# EasyEDA Pro project Q's HelloWorld KeyBoard.eprj, schematic SCH数字键盘主控板
Create Date: 2022-10-16; Page Name: P1; Project Name: Q's HelloWorld KeyBoard; Schematic Name: SCH数字键盘主控板; Update Date: 2022-10-17; Company: 嘉立创EDA; Page Size: A3; Version: V1.0
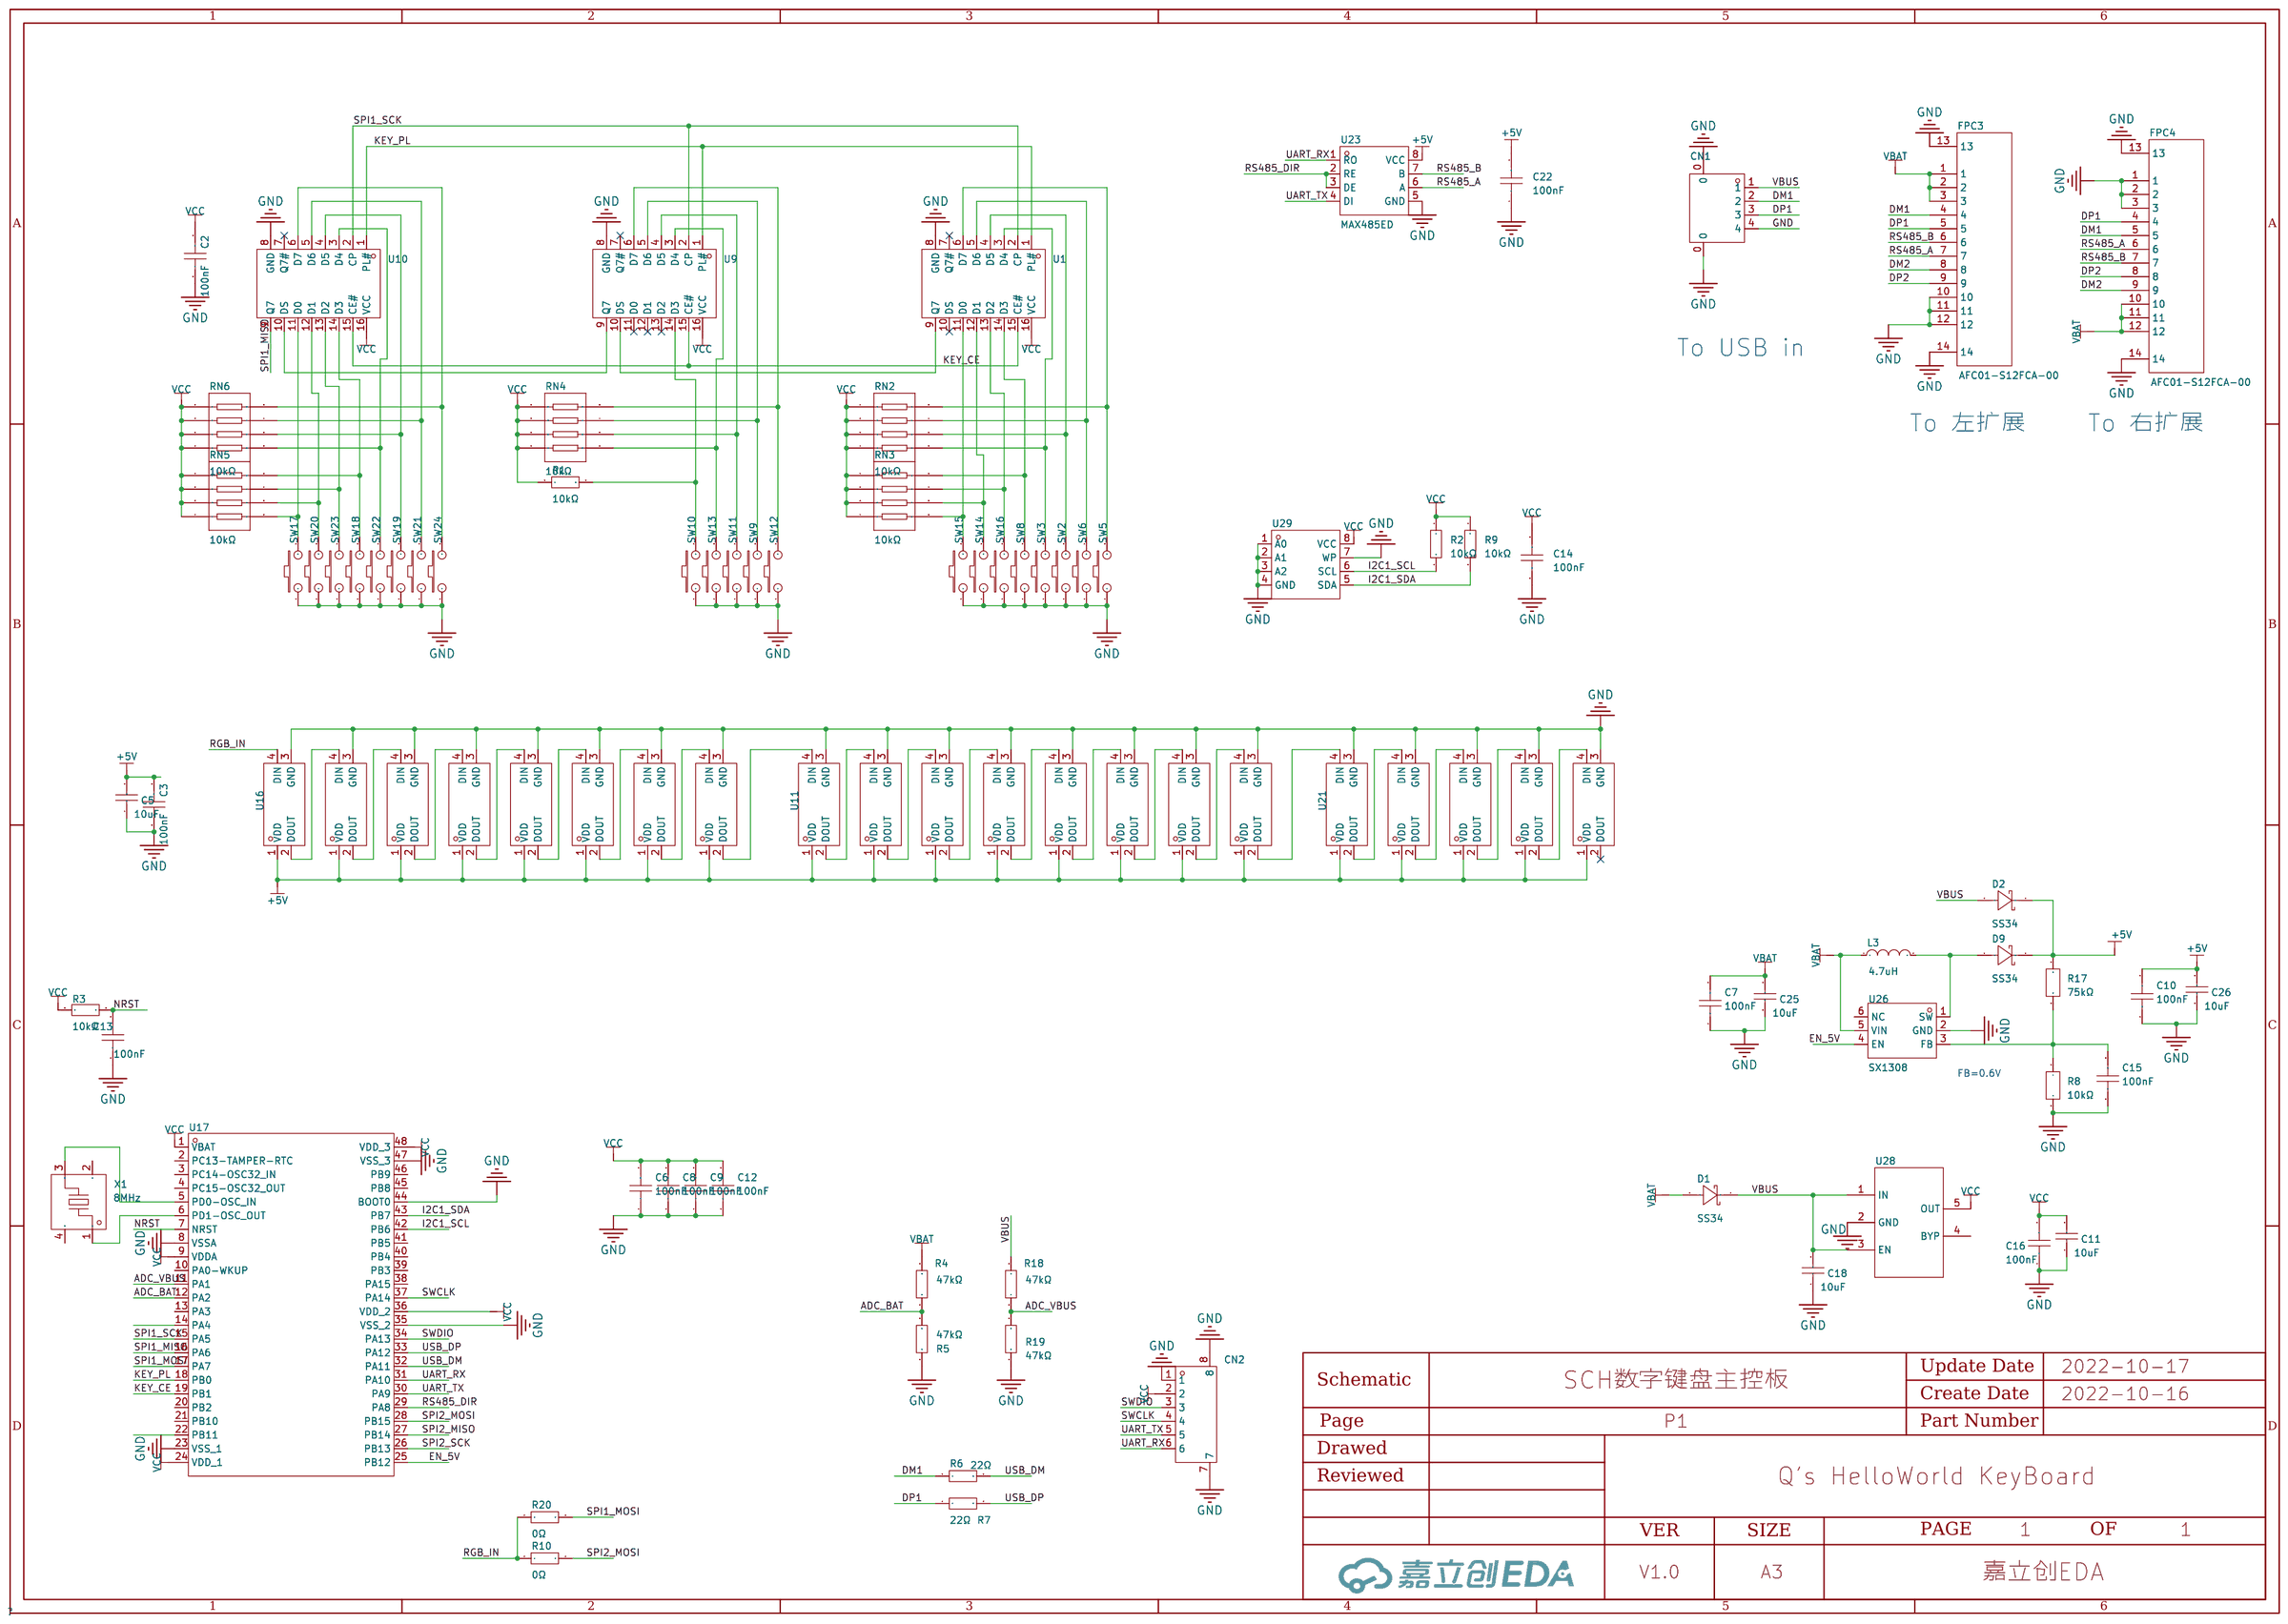
[diagram p9: schematic sheet]

## Parts
C2  100nF  [C0402]
C3  100nF  [C0402]
C5  10uF  [C0402]
C6  100nF  [C0402]
C7  100nF  [C0402]
C8  100nF  [C0402]
C9  100nF  [C0402]
C10  100nF  [C0402]
C11  10uF  [C0402]
C12  100nF  [C0402]
C13  100nF  [C0402]
C14  100nF  [C0402]
C15  100nF  [C0402]
C16  100nF  [C0402]
C18  10uF  [C0402]
C22  100nF  [C0402]
C25  10uF  [C0402]
C26  10uF  [C0402]
CN1  1.0T-4P卧贴  [CONN-SMD_1.0T-4P]
CN2  1.0K-BH-6PWB  [CONN-SMD_6P-P1.00_HDGC_1.0K-BH-6PWB]
D1  SS34  [SMA_L4.3-W2.6-LS5.2-RD]
D2  SS34  [SMA_L4.3-W2.6-LS5.2-RD]
D9  SS34  [SMA_L4.3-W2.6-LS5.2-RD]
FPC3  AFC01-S12FCA-00  [FPC-SMD_AFC01-S12FCA-00]
FPC4  AFC01-S12FCA-00  [FPC-SMD_AFC01-S12FCA-00]
L3  4.7uH  [IND-SMD_L5.8-W5.2]
R1  10kΩ  [R0402]
R2  10kΩ  [R0402]
R3  10kΩ  [R0402]
R4  47kΩ  [R0402]
R5  47kΩ  [R0402]
R6  22Ω  [R0402]
R7  22Ω  [R0402]
R8  10kΩ  [R0402]
R9  10kΩ  [R0402]
R10  0Ω  [R0402]
R17  75kΩ  [R0402]
R18  47kΩ  [R0402]
R19  47kΩ  [R0402]
R20  0Ω  [R0402]
RN2  10kΩ  [RES-ARRAY-SMD_0402-8P-L2.0-W1.0-BL]
RN3  10kΩ  [RES-ARRAY-SMD_0402-8P-L2.0-W1.0-BL]
RN4  10kΩ  [RES-ARRAY-SMD_0402-8P-L2.0-W1.0-BL]
RN5  10kΩ  [RES-ARRAY-SMD_0402-8P-L2.0-W1.0-BL]
RN6  10kΩ  [RES-ARRAY-SMD_0402-8P-L2.0-W1.0-BL]
SW2  -  [轴座_焊接热插拔_不带灯]
SW3  -  [轴座_焊接热插拔_不带灯]
SW5  -  [轴座_焊接热插拔_不带灯]
SW6  -  [轴座_焊接热插拔_不带灯]
SW8  -  [轴座_焊接热插拔_不带灯]
SW9  -  [轴座_焊接热插拔_不带灯]
SW10  -  [轴座_焊接热插拔_不带灯]
SW11  -  [轴座_焊接热插拔_不带灯]
SW12  -  [轴座_焊接热插拔_不带灯]
SW13  -  [轴座_焊接热插拔_不带灯]
SW14  -  [轴座_焊接热插拔_不带灯]
SW15  -  [轴座_焊接热插拔_不带灯]
SW16  -  [轴座_焊接热插拔_不带灯]
SW17  -  [轴座_焊接热插拔_不带灯]
SW18  -  [轴座_焊接热插拔_不带灯]
SW19  -  [轴座_焊接热插拔_不带灯]
SW20  -  [轴座_焊接热插拔_不带灯]
SW21  -  [轴座_焊接热插拔_不带灯]
SW22  -  [轴座_焊接热插拔_不带灯]
SW23  -  [轴座_焊接热插拔_不带灯]
SW24  -  [轴座_焊接热插拔_不带灯]
U1  74HC165D,653  [SOIC-16_L9.9-W3.9-P1.27-LS6.0-BL]
U2  Yo-WS2812B-3528反贴雾状  [LED-SMD_L3.2-W2.8-BR_DY-S352818]
U3  Yo-WS2812B-3528反贴雾状  [LED-SMD_L3.2-W2.8-BR_DY-S352818]
U4  Yo-WS2812B-3528反贴雾状  [LED-SMD_L3.2-W2.8-BR_DY-S352818]
U5  Yo-WS2812B-3528反贴雾状  [LED-SMD_L3.2-W2.8-BR_DY-S352818]
U6  Yo-WS2812B-3528反贴雾状  [LED-SMD_L3.2-W2.8-BR_DY-S352818]
U7  Yo-WS2812B-3528反贴雾状  [LED-SMD_L3.2-W2.8-BR_DY-S352818]
U8  Yo-WS2812B-3528反贴雾状  [LED-SMD_L3.2-W2.8-BR_DY-S352818]
U9  74HC165D,653  [SOIC-16_L9.9-W3.9-P1.27-LS6.0-BL]
U10  74HC165D,653  [SOIC-16_L9.9-W3.9-P1.27-LS6.0-BL]
U11  Yo-WS2812B-3528反贴雾状  [LED-SMD_L3.2-W2.8-BR_DY-S352818]
U12  Yo-WS2812B-3528反贴雾状  [LED-SMD_L3.2-W2.8-BR_DY-S352818]
U13  Yo-WS2812B-3528反贴雾状  [LED-SMD_L3.2-W2.8-BR_DY-S352818]
U14  Yo-WS2812B-3528反贴雾状  [LED-SMD_L3.2-W2.8-BR_DY-S352818]
U15  Yo-WS2812B-3528反贴雾状  [LED-SMD_L3.2-W2.8-BR_DY-S352818]
U16  Yo-WS2812B-3528反贴雾状  [LED-SMD_L3.2-W2.8-BR_DY-S352818]
U17  STM32F103C8T6  [LQFP-48_L7.0-W7.0-P0.50-LS9.0-BL]
U18  Yo-WS2812B-3528反贴雾状  [LED-SMD_L3.2-W2.8-BR_DY-S352818]
U19  Yo-WS2812B-3528反贴雾状  [LED-SMD_L3.2-W2.8-BR_DY-S352818]
U20  Yo-WS2812B-3528反贴雾状  [LED-SMD_L3.2-W2.8-BR_DY-S352818]
U21  Yo-WS2812B-3528反贴雾状  [LED-SMD_L3.2-W2.8-BR_DY-S352818]
U22  Yo-WS2812B-3528反贴雾状  [LED-SMD_L3.2-W2.8-BR_DY-S352818]
U23  MAX485ED  [SOP-8_L4.9-W3.9-P1.27-LS6.0-BL]
U24  Yo-WS2812B-3528反贴雾状  [LED-SMD_L3.2-W2.8-BR_DY-S352818]
U25  Yo-WS2812B-3528反贴雾状  [LED-SMD_L3.2-W2.8-BR_DY-S352818]
U26  SX1308  [SOT-23-6_L2.9-W1.6-P0.95-LS2.8-BR]
U27  Yo-WS2812B-3528反贴雾状  [LED-SMD_L3.2-W2.8-BR_DY-S352818]
U28  -  [SOT-23-5_L3.0-W1.7-P0.95-LS2.8-BR]
U29  AT24C02  [SOP-8_L5.0-W4.0-P1.27-LS6.0-BL]
X1  8MHz  [OSC-SMD_4P-L3.2-W2.5-BL]

## Library data of the parts
C2 C3 C6-C10 C12-C16 C22 = GCM155R71C104KA55J: 容值:100nF;精度:±10%;额定电压:-;材质(温度系数):-;; LCSC Part Name: 100nF ±10%; Supplier Part: C2655418; Manufacturer: muRata(村田); Supplier Footprint: 0402; JLCPCB Part Class: Extended Part; Datasheet: https://atta.szlcsc.com/upload/public/pdf/source/20210701/42090801FDE37D0E45AFF657247F4A08.pdf; Supplier: LCSC; Tolerance: ±10%
C5 C11 C18 C25 C26 = CL05A106MQ5NUNC: 容值:10uF;精度:±20%;额定电压:6.3V;材质(温度系数):X5R;; LCSC Part Name: 10uF ±20% 6.3V; Supplier Part: C15525; Manufacturer: SAMSUNG(三星); Supplier Footprint: 0402; JLCPCB Part Class: Basic Part; Datasheet: https://atta.szlcsc.com/upload/public/pdf/source/20220823/2B02EE04F8F211D38A52DCB16EB6BEBA.pdf; Supplier: LCSC; Tolerance: ±20%; Voltage Rated: 6.3V; Temperature Coefficient: X5R
CN1 = 1.0T-4P卧贴: 参考系列:SH;间距:1mm;插针结构:1x4P;排数:1;每排PIN数:4;行距:-;安装方式:-;触头材质:磷铜;; LCSC Part Name: 插座 1*4P 卧贴 卧贴; Supplier Part: C145956; Manufacturer: BOOMELE(博穆精密); Supplier Footprint: SMD,P=1mm; JLCPCB Part Class: Extended Part; Datasheet: https://atta.szlcsc.com/upload/public/pdf/source/20171115/C145956_15107293415261120441.pdf; Supplier: LCSC; Reference Series: SH; Pitch: 1mm; Pins Structure: 1x4P; Number of Rows: 1; Number of PINs Per Row: 4; Contact Material: 磷铜
CN2 = 1.0K-BH-6PWB: 参考系列:-;间距:1mm;插针结构:1x6P;排数:1;每排PIN数:6;行距:-;公母:公型插针;安装方式:卧贴;额定电流:-;工作温度范围:-25~+85;; LCSC Part Name: 1x6P 间距P=1.0mm 卧贴 SMT; Supplier Part: C2919607; Manufacturer: HDGC(华德共创); Supplier Footprint: SMD,P=1mm; JLCPCB Part Class: Extended Part; Datasheet: https://atta.szlcsc.com/upload/public/pdf/source/20211115/0C4A9B301513FDEAA34F959002791CED.pdf; Supplier: LCSC; Pitch: 1mm; Pins Structure: 1x6P; Number of Rows: 1; Number of PINs Per Row: 6; Gender: 公型插针; Mounting Style: 卧贴; Operating Temperature Range: -25~+85
D1 D2 D9 = SS34_C3032484: Supplier Part: C3032484; Manufacturer: TDD(台冠电子); Supplier Footprint: SMA; JLCPCB Part Class: Extended Part; Datasheet: https://atta.szlcsc.com/upload/public/pdf/source/20220622/9D70D0693761B542BF6F533590093AA5.pdf; Supplier: LCSC
FPC3 FPC4 = AFC01-S12FCA-00: 间距:0.5mm;触点数量:12;锁定特性:翻盖式;安装类型:卧贴;触点类型:下接;; LCSC Part Name: 0.5mm P数:12 翻盖式 下接; Supplier Part: C262661; Manufacturer: JS(钜硕电子); Supplier Footprint: SMD,P=0.5mm; JLCPCB Part Class: Extended Part; Datasheet: https://atta.szlcsc.com/upload/public/pdf/source/20180810/C262661_216573474FA4FCB7E7D6D6C5859A7896.pdf; Supplier: LCSC; Pitch: 0.5mm; Number of Contacts: 12; Locking Feature: 翻盖式; Mounting Type: 卧贴; Contact Type: 下接; Height Above Board: 2mm; FFC, FCB Thickness: 0.3mm
L3 = CD54-4R7M-T-Z: 电感值:4.7uH;精度:±20%;额定电流:-;直流电阻(DCR):-;; LCSC Part Name: 4.7uH ±20%; Supplier Part: C501775; Manufacturer: Me-TECH(美台高科); Supplier Footprint: SMD; JLCPCB Part Class: Extended Part; Datasheet: https://atta.szlcsc.com/upload/public/pdf/source/20200324/C501728_0ED92A661C9AA91DB0CB8AF3A2A8117A.pdf; Supplier: LCSC; Tolerance: ±20%
R1 = RC0402FR-0710KL: 最大工作电压:50V;阻值:10kΩ;工作温度范围:-55~+155;电阻长:-;精度:±1%;电阻直径:-;电阻高:-;电阻宽:-;电阻类型:厚膜电阻;功率:62.5mW;温度系数:±100ppm/;; LCSC Part Name: 10kΩ ±1%; Supplier Part: C60490; Manufacturer: YAGEO(国巨); Supplier Footprint: 0402; JLCPCB Part Class: Extended Part; Datasheet: https://atta.szlcsc.com/upload/public/pdf/source/20170606/1496716515432.pdf; Supplier: LCSC; Overload Voltage (Max): 50V; Operating Temperature Range: -55~+155; Tolerance: ±1%; Type: 厚膜电阻; Power(Watts): 62.5mW; Temperature Coefficient: ±100ppm/
R2 R3 R9 = AECR0402F10K0K9: 功率:0.063W;阻值:10kΩ;精度:±1%;; LCSC Part Name: 10KΩ(1002) ±1%; Supplier Part: C328298; Manufacturer: RESI(开步睿思）; Supplier Footprint: 0402; JLCPCB Part Class: Extended Part; Datasheet: https://atta.szlcsc.com/upload/public/pdf/source/20181108/C328298_2E8721712DFDC25EDA989FDD55A2877F.pdf; Supplier: LCSC; Power(Watts): 0.063W; Tolerance: ±1%
R4 R5 R18 R19 = RC-02W4702FT: 阻值:47kΩ;精度:±1%;功率:62.5mW;温度系数:±200ppm/;最大工作电压:50V;工作温度范围:-55~+155;; LCSC Part Name: 47kΩ ±1% 62.5mW; Supplier Part: C286560; Manufacturer: FH(风华); Supplier Footprint: 0402; JLCPCB Part Class: Extended Part; Datasheet: https://atta.szlcsc.com/upload/public/pdf/source/20180928/C286560_BD6B595325C950E64D46B3EA58FB4E6A.pdf; Supplier: LCSC; Tolerance: ±1%; Power(Watts): 62.5mW; Temperature Coefficient: ±200ppm/; Overload Voltage (Max): 50V; Operating Temperature Range: -55~+155
R6 R7 = RC0402FR-0722RL: 最大工作电压:50V;工作温度范围:-55~+155;电阻长:-;精度:±1%;电阻直径:-;电阻高:-;电阻宽:-;电阻类型:厚膜电阻;功率:62.5mW;温度系数:±100ppm/;阻值:22Ω;; LCSC Part Name: 22Ω ±1%; Supplier Part: C114765; Manufacturer: YAGEO(国巨); Supplier Footprint: 0402; JLCPCB Part Class: Extended Part; Datasheet: https://atta.szlcsc.com/upload/public/pdf/source/20170912/C114765_1505207820880963483.pdf; Supplier: LCSC; Overload Voltage (Max): 50V; Operating Temperature Range: -55~+155; Tolerance: ±1%; Type: 厚膜电阻; Power(Watts): 62.5mW; Temperature Coefficient: ±100ppm/
R8 R17 = CRCW0402100KJNED: 电阻类型:-;阻值:100kΩ;精度:±5%;功率:63mW;温度系数:±200ppm/K;最大工作电压:75V;工作温度范围:-55~+155;; LCSC Part Name: 100kΩ ±5%; Supplier Part: C482245; Manufacturer: VISHAY(威世); Supplier Footprint: 0402; JLCPCB Part Class: Extended Part; Datasheet: https://atta.szlcsc.com/upload/public/pdf/source/20200618/C481956_E25174B008CE8C884BEDD7D4D15E674F.pdf; Supplier: LCSC; Tolerance: ±5%; Power(Watts): 63mW; Temperature Coefficient: ±200ppm/K; Overload Voltage (Max): 75V; Operating Temperature Range: -55~+155
R10 R20 = 0402WGJ0000TCE: 温度系数:-;精度:±5%;功率:1/16W;阻值:0Ω;最大工作电压:50V;工作温度范围:-55~+155;; LCSC Part Name: 0Ω ±5%; Supplier Part: C21376; Manufacturer: UNI-ROYAL(厚声); Supplier Footprint: 0402; JLCPCB Part Class: Extended Part; Datasheet: https://atta.szlcsc.com/upload/public/pdf/source/20170920/C21376_1505887444166980543.pdf; Supplier: LCSC; Tolerance: ±5%; Power(Watts): 1/16W; Overload Voltage (Max): 50V; Operating Temperature Range: -55~+155
RN2-RN6 = 4D02WGJ0103TCE: 阻值:10kΩ;精度:±5%;单个元件功率:62.5mW;温度系数:±200ppm/;电阻器数:4;引脚数:8;; LCSC Part Name: 10kΩ ±5%; Supplier Part: C25725; Manufacturer: UNI-ROYAL(厚声); Supplier Footprint: 0402x4; JLCPCB Part Class: Basic Part; Datasheet: https://atta.szlcsc.com/upload/public/pdf/source/20170615/1497510998113.pdf; Supplier: LCSC; Tolerance: ±5%; Power(Watts): 62.5mW; Temperature Coefficient: ±200ppm/; Number of Resistors: 4; Number of Pins: 8
SW2 SW3 SW5 SW6 SW8-SW24 = KEYBOARD-SW: Origin Footprint 2: MX-KEY
U1 U9 U10 = 74HC165D,653: Supplier Part: C5613; Manufacturer: Nexperia(安世); Supplier Footprint: SOIC-16_150mil; JLCPCB Part Class: Basic Part; Datasheet: https://atta.szlcsc.com/upload/public/pdf/source/20160218/1457707760975.pdf; Supplier: LCSC
U2-U8 U11-U16 U18-U22 U24 U25 U27 = YO-WS2812B-3528反贴: Supplier: LCSC; Supplier Part: C9900003682; Manufacturer: null
U17 = STM32F103C8T6: CPU内核:ARM Cortex-M3;CPU最大主频:72MHz;工作电压范围:2V~3.6V;内部振荡器:有;程序 FLASH容量:64K@x8bit;RAM总容量:20KB;EEPROM/数据 FLASH容量:-;GPIO端口数量:37;ADC(单元数/通道数/位数):1@x10ch/12bit;外设/功能/协议栈:温度传感器；DMA；看门狗；POR；PWM;工作温度范围:-40~+85;; LCSC Part Name: ARM Cortex-M3 72MHz 64K@x8bit 20KB MSL=3; Supplier Part: C8734; Manufacturer: ST(意法半导体); Supplier Footprint: LQFP-48_7x7x05P; JLCPCB Part Class: Basic Part; Datasheet: https://atta.szlcsc.com/upload/public/pdf/source/20140724/1457707174202.pdf; Supplier: LCSC; CPU Core: ARM Cortex-M3; Maximum Frequency: 72MHz; Supply Voltage Range: 2V~3.6V; Internal Oscillator: 有; Program FLASH Size: 64K@x8bit; RAM Size: 20KB; GPIO Ports Number: 37; ADC (Units/Channels/bits): 1@x10ch/12bit; Peripherals / Functions / Protocol Stacks: 温度传感器；DMA；看门狗；POR；PWM; Operating Temperature Range: -40~+85
U23 = MAX485ED: 类型:-;协议类别:-;驱动器/接收器数:-;数据速率:-;; Supplier Part: C481667; Manufacturer: HTC; Supplier Footprint: SOP-8; JLCPCB Part Class: Extended Part; Datasheet: https://atta.szlcsc.com/upload/public/pdf/source/20200113/C481667_86CA12344B2034BBC3F3085D860BEB7C.pdf; Supplier: LCSC
U26 = SX1308: 功能类型:升压型;同步整流:否;输出通道数:1;拓扑结构:升压式;输入电压:2V~24V;输出电压:28V;输出电流(最大值):-;开关频率:1.2MHz;; LCSC Part Name: 升压型 2V~24V 1.2MHz; Supplier Part: C78162; Manufacturer: SX(硕芯科技); Supplier Footprint: SOT-23-6; JLCPCB Part Class: Extended Part; Datasheet: https://atta.szlcsc.com/upload/public/pdf/source/20160920/1474356679185.pdf; Supplier: LCSC; Function: 升压型; Synchronous Rectification: 否; Number of Outputs: 1; Topology: 升压式; Input Voltage: 2V~24V; Output Voltage: 28V; Switching Frequency: 1.2MHz
U28 = SPX3819M5-L-3-3/TR: 输出类型:固定;输出极性:正;输出通道数:1;最大输入电压:16V;输出电压:3.3V;压差:700mV@(500mA);输出电流:500mA;电源纹波抑制比(PRSS):70dB;; LCSC Part Name: Vin=16V Vout=3.3V 500mA 70dB; Supplier Part: C9055; Manufacturer: MaxLinear; Supplier Footprint: SOT-23-5; JLCPCB Part Class: 扩展库; Datasheet: https://atta.szlcsc.com/upload/public/pdf/source/20160421/1461205045150.pdf; Supplier: LCSC; Output Type: 固定; Output Polarity: 正; Number of Outputs: 1; Maximum Input Voltage: 16V; Output Voltage: 3.3V; Dropout Voltage: 700mV@(500mA); Output Current: 500mA; Power Supply Rejection Ratio (PRSS): 70dB
U29 = AT24C02_C688857: Supplier Part: C688857; Manufacturer: IDCHIP(英锐芯); Supplier Footprint: SOP-8; JLCPCB Part Class: Extended Part; Datasheet: https://atta.szlcsc.com/upload/public/pdf/source/20200619/C688857_168265888F77B455D6D4136881F4BB15.pdf; Supplier: LCSC
X1 = 3225-8.00-10-10-10/A: 晶振类型:贴片无源晶振;频率:8MHz;频率公差:±10ppm;频率稳定度:-;负载电容:10pF;工作温度:-;; LCSC Part Name: 8MHz ±10ppm 10pF; Supplier Part: C518154; Manufacturer: LIMING(利明); Supplier Footprint: SMD3225-4P; JLCPCB Part Class: Extended Part; Datasheet: https://atta.szlcsc.com/upload/public/pdf/source/20200603/C518143_C28693AFC6B5677A46756E3C75F63174.pdf; Supplier: LCSC; Crystal Type: 贴片无源晶振; Frequency Tolerance: ±10ppm; Load Capacitance: 10pF

## Nets
+5V: C3.1 C5.2 C10.2 C22.2 C26.2 D2.1(K) D9.1(K) R17.1 U2.1(VDD) U3.1(VDD) U4.1(VDD) U5.1(VDD) U6.1(VDD) U7.1(VDD) U8.1(VDD) U11.1(VDD) U12.1(VDD) U13.1(VDD) U14.1(VDD) U15.1(VDD) U16.1(VDD) U18.1(VDD) U19.1(VDD) U20.1(VDD) U21.1(VDD) U22.1(VDD) U23.8(VCC) U24.1(VDD) U25.1(VDD) U27.1(VDD)
GND: C2.2 C3.2 C5.1 C6.1 C7.1 C8.1 C9.1 C10.1 C11.1 C12.1 C13.1 C14.1 C15.1 C16.1 C18.1 C22.1 C25.1 C26.1 CN1.0 CN1.4 CN2.1 CN2.7 CN2.8 FPC3.10 FPC3.11 FPC3.12 FPC3.13 FPC3.14 FPC4.1 FPC4.2 FPC4.3 FPC4.13 FPC4.14 R5.1 R8.2 R19.1 SW2.1 SW3.1 SW5.1 SW6.1 SW8.1 SW9.1 SW10.1 SW11.1 SW12.1 SW13.1 SW14.1 SW15.1 SW16.1 SW17.1 SW18.1 SW19.1 SW20.1 SW21.1 SW22.1 SW23.1 SW24.1 U1.8(GND) U2.3(GND) U3.3(GND) U4.3(GND) U5.3(GND) U6.3(GND) U7.3(GND) U8.3(GND) U9.8(GND) U10.8(GND) U11.3(GND) U12.3(GND) U13.3(GND) U14.3(GND) U15.3(GND) U16.3(GND) U17.8(VSSA) U17.23(VSS_1) U17.35(VSS_2) U17.44(BOOT0) U17.47(VSS_3) U18.3(GND) U19.3(GND) U20.3(GND) U21.3(GND) U22.3(GND) U23.5(GND) U24.3(GND) U25.3(GND) U26.2(GND) U27.3(GND) U28.2(GND) U29.1(A0) U29.2(A1) U29.3(A2) U29.4(GND) U29.7(WP)
VBAT: C7.2 C25.2 D1.2(A) FPC3.1 FPC3.2 FPC3.3 FPC4.10 FPC4.11 FPC4.12 L3.1 R4.2 U26.5(VIN)
VBUS: C18.2 CN1.1 D1.1(K) D2.2(A) R18.2 U28.1(IN) U28.3(EN)
VCC: C2.1 C6.2 C8.2 C9.2 C11.2 C12.2 C14.2 C16.2 CN2.2 R1.1 R2.1 R3.2 R9.1 RN2.1 RN2.2 RN2.3 RN2.4 RN3.1 RN3.2 RN3.3 RN3.4 RN4.1 RN4.2 RN4.3 RN4.4 RN5.1 RN5.2 RN5.3 RN5.4 RN6.1 RN6.2 RN6.3 RN6.4 U1.16(VCC) U9.16(VCC) U10.16(VCC) U17.1(VBAT) U17.9(VDDA) U17.24(VDD_1) U17.36(VDD_2) U17.48(VDD_3) U28.5(OUT) U29.8(VCC)
ADC_BAT: R4.1 R5.2 U17.12(PA2)
ADC_VBUS: R18.1 R19.2 U17.11(PA1)
DM1: CN1.2 FPC3.4 FPC4.5 R6.1
DM2: FPC3.8 FPC4.9
DP1: CN1.3 FPC3.5 FPC4.4 R7.1
DP2: FPC3.9 FPC4.8
EN_5V: U17.25(PB12) U26.4(EN)
I2C1_SCL: R2.2 U17.42(PB6) U29.6(SCL)
I2C1_SDA: R9.2 U17.43(PB7) U29.5(SDA)
KEY_CE: U1.15(CE#) U9.15(CE#) U10.15(CE#) U17.19(PB1)
KEY_PL: U1.1(PL#) U9.1(PL#) U10.1(PL#) U17.18(PB0)
NRST: C13.2 R3.1 U17.7(NRST)
RGB_IN: R10.1 R20.1 U16.4(DIN)
RS485_A: FPC3.7 FPC4.6 U23.6(A)
RS485_B: FPC3.6 FPC4.7 U23.7(B)
RS485_DIR: U17.29(PA8) U23.2(RE) U23.3(DE)
SPI1_MISO: U10.9(Q7) U17.16(PA6)
SPI1_MOSI: R20.2 U17.17(PA7)
SPI1_SCK: U1.2(CP) U9.2(CP) U10.2(CP) U17.15(PA5)
SPI2_MISO: U17.27(PB14)
SPI2_MOSI: R10.2 U17.28(PB15)
SPI2_SCK: U17.26(PB13)
SWCLK: CN2.4 U17.37(PA14)
SWDIO: CN2.3 U17.34(PA13)
UART_RX: CN2.6 U17.31(PA10) U23.1(RO)
UART_TX: CN2.5 U17.30(PA9) U23.4(DI)
USB_DM: R6.2 U17.32(PA11)
USB_DP: R7.2 U17.33(PA12)
$1N1785: RN2.5 SW3.2 U1.3(D4)
$1N1786: RN2.8 SW5.2 U1.6(D7)
$1N1802: RN2.6 SW2.2 U1.4(D5)
$1N1803: RN2.7 SW6.2 U1.5(D6)
$1N1804: U4.4(DIN) U16.2(DOUT)
$1N1805: U4.2(DOUT) U7.4(DIN)
$1N1806: U2.4(DIN) U7.2(DOUT)
$1N1807: U2.2(DOUT) U5.4(DIN)
$1N1808: U3.4(DIN) U5.2(DOUT)
$1N1809: U6.2(DOUT) U8.4(DIN)
$1N1810: U3.2(DOUT) U6.4(DIN)
$1N8634: RN4.5 SW13.2 U9.3(D4)
$1N8635: RN4.8 SW12.2 U9.6(D7)
$1N8644: RN4.6 SW11.2 U9.4(D5)
$1N8645: RN4.7 SW9.2 U9.5(D6)
$1N9662: RN6.5 SW22.2 U10.3(D4)
$1N9663: RN6.8 SW24.2 U10.6(D7)
$1N9672: RN6.6 SW19.2 U10.4(D5)
$1N9673: RN6.7 SW21.2 U10.5(D6)
$1N9674: RN5.5 SW17.2 U10.11(D0)
$1N9675: RN5.6 SW20.2 U10.12(D1)
$1N9676: RN5.7 SW23.2 U10.13(D2)
$1N9677: RN5.8 SW18.2 U10.14(D3)
$1N12275: U1.9(Q7) U9.10(DS)
$1N12619: U9.9(Q7) U10.10(DS)
$1N14540: U11.2(DOUT) U14.4(DIN)
$1N14541: U14.2(DOUT) U19.4(DIN)
$1N14542: U12.4(DIN) U19.2(DOUT)
$1N14543: U12.2(DOUT) U15.4(DIN)
$1N14544: U13.4(DIN) U15.2(DOUT)
$1N14545: U18.2(DOUT) U20.4(DIN)
$1N14546: U13.2(DOUT) U18.4(DIN)
$1N15274: U21.2(DOUT) U24.4(DIN)
$1N15275: U24.2(DOUT) U27.4(DIN)
$1N15276: U22.4(DIN) U27.2(DOUT)
$1N15277: U22.2(DOUT) U25.4(DIN)
$1N15621: U8.2(DOUT) U11.4(DIN)
$1N16475: U20.2(DOUT) U21.4(DIN)
$1N19920: D9.2(A) L3.2 U26.1(SW)
$1N19921: C15.2 R8.1 R17.2 U26.3(FB)
$1N26782: U17.6(PD1-OSC_OUT) X1.1
$1N27057: U17.5(PD0-OSC_IN) X1.3
$1N58499: R1.2 SW10.2 U9.14(D3)
$1N68678: RN3.8 SW8.2 U1.14(D3)
$1N68963: RN3.7 SW16.2 U1.13(D2)
$1N69250: RN3.6 SW14.2 U1.12(D1)
$1N69539: RN3.5 SW15.2 U1.11(D0)

Not connected (* = marked no-connect by the designer): U1 7(Q7#)* 10(DS)*; U9 7(Q7#)* 11(D0)* 12(D1)* 13(D2)*; U10 7(Q7#)*; U17 2(PC13-TAMPER-RTC) 3(PC14-OSC32_IN) 4(PC15-OSC32_OUT) 10(PA0-WKUP) 13(PA3) 14(PA4) 20(PB2) 21(PB10) 22(PB11) 38(PA15) 39(PB3) 40(PB4) 41(PB5) 45(PB8) 46(PB9); U25 2(DOUT)*; U26 6(NC); U28 4(BYP); X1 2(GND) 4(GND)

## Notes on the sheet
- To USB in
- To 左扩展
- To 右扩展
- FB=0.6V
